# EasyEDA Pro project ProProject_IMUSensorNodes202312.epro, board 6_6_拼板20240123（带编号） (continued)
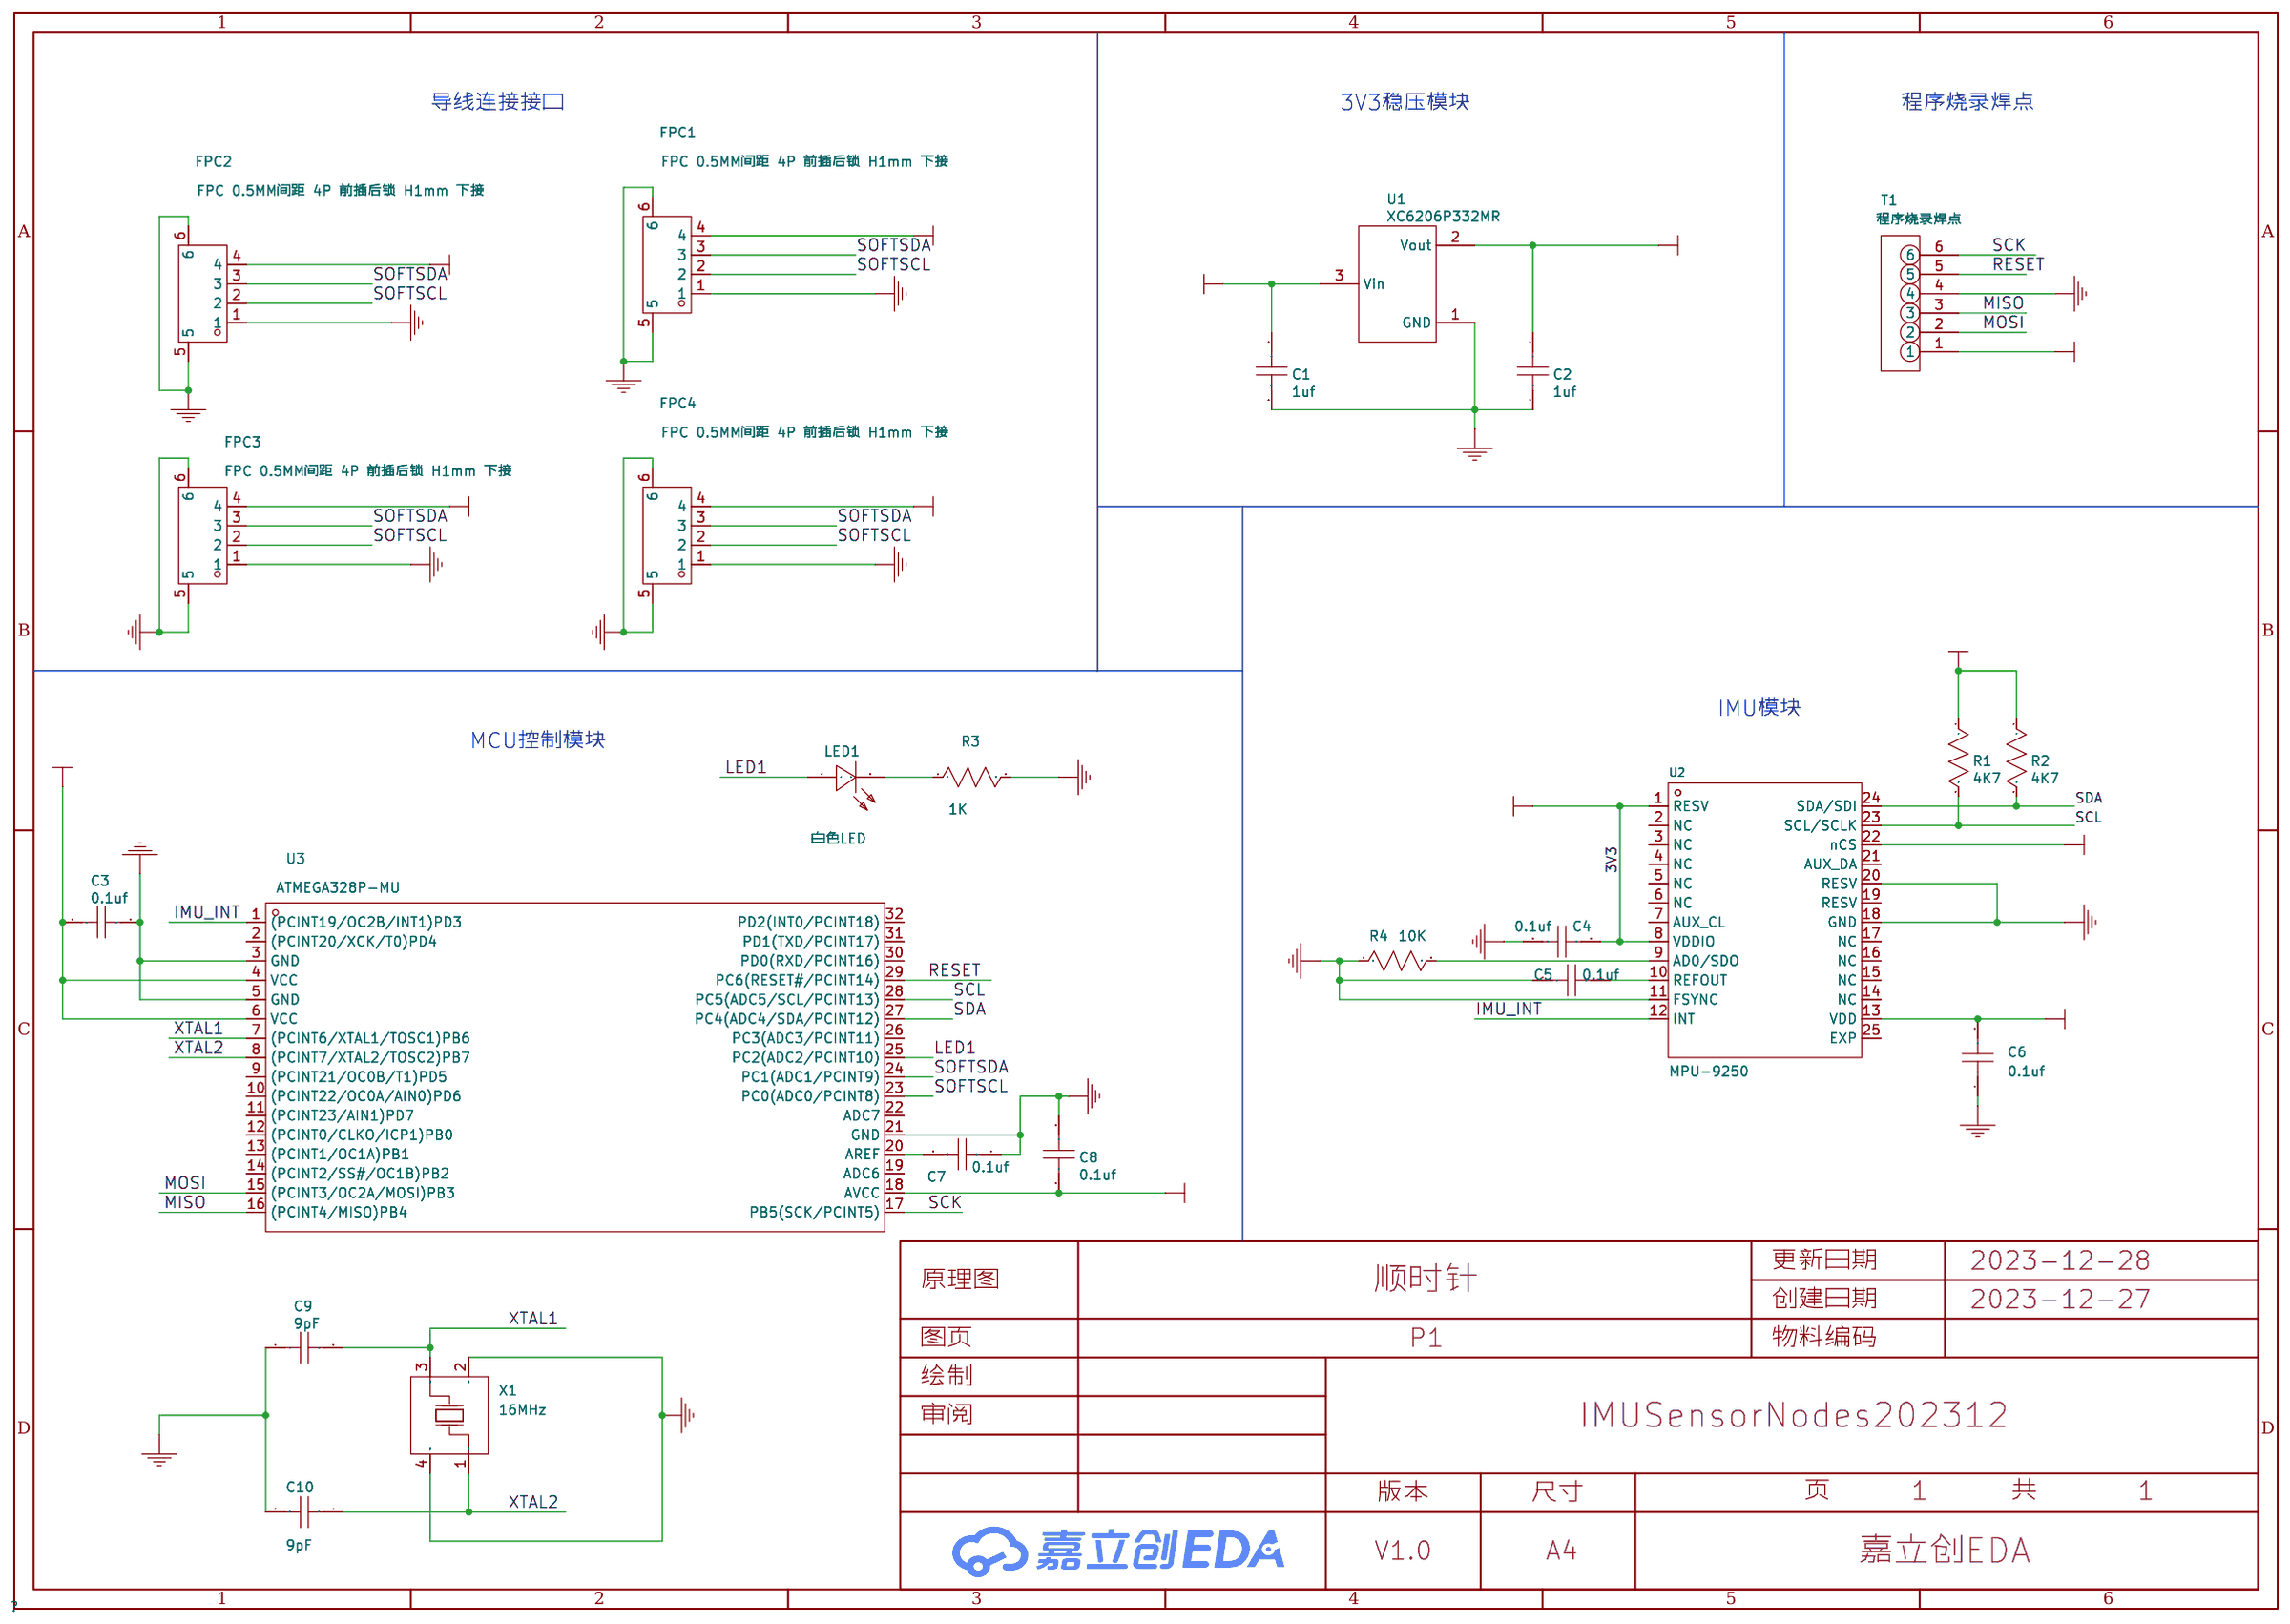
[diagram p0: schematic sheet]
## Nets (continued)
Designator#910.5 Designator#910.21 Designator#910.33 Designator#911.11 Designator#911.18 Designator#911.20 Designator#911.25 Designator#912.11 Designator#912.18 Designator#912.20 Designator#912.25 Designator#913.3 Designator#913.5 Designator#913.21 Designator#913.33 Designator#914.4 Designator#915.11 Designator#915.18 Designator#915.20 Designator#915.25 Designator#916.3 Designator#916.5 Designator#916.21 Designator#916.33 Designator#917.3 Designator#917.5 Designator#917.21 Designator#917.33 Designator#918.11 Designator#918.18 Designator#918.20 Designator#918.25 Designator#919.11 Designator#919.18 Designator#919.20 Designator#919.25 Designator#920.3 Designator#920.5 Designator#920.21 Designator#920.33 Designator#921.11 Designator#921.18 Designator#921.20 Designator#921.25 Designator#922.4 Designator#923.11 Designator#923.18 Designator#923.20 Designator#923.25 Designator#924.4
IMU_INT: Designator#313.1 Designator#314.12 Designator#317.12 Designator#318.12 Designator#319.12 Designator#321.1 Designator#322.1 Designator#323.12 Designator#324.1 Designator#325.1 Designator#326.12 Designator#437.12 Designator#438.12 Designator#440.1 Designator#801.1 Designator#803.1 Designator#806.1 Designator#808.1 Designator#809.1 Designator#810.1 Designator#811.1 Designator#813.12 Designator#814.12 Designator#818.12 Designator#819.12 Designator#820.1 Designator#822.1 Designator#826.12 Designator#827.1 Designator#829.1 Designator#830.12 Designator#831.12 Designator#832.1 Designator#835.1 Designator#836.12 Designator#837.1 Designator#838.1 Designator#839.1 Designator#877.12 Designator#878.12 Designator#880.12 Designator#881.12 Designator#882.12 Designator#883.12 Designator#885.1 Designator#886.12 Designator#888.12 Designator#889.1 Designator#890.12 Designator#892.1 Designator#895.1 Designator#896.1 Designator#897.12 Designator#900.12 Designator#901.12 Designator#902.1 Designator#903.1 Designator#904.1 Designator#906.1 Designator#909.12 Designator#910.1 Designator#911.12 Designator#912.12 Designator#913.1 Designator#915.12 Designator#916.1 Designator#917.1 Designator#918.12 Designator#919.12 Designator#920.1 Designator#921.12 Designator#923.12
LED1: Designator#246.1 Designator#247.1 Designator#248.1 Designator#249.1 Designator#250.1 Designator#251.1 Designator#252.1 Designator#253.1 Designator#254.1 Designator#255.1 Designator#256.1 Designator#257.1 Designator#258.1 Designator#259.1 Designator#260.1 Designator#261.1 Designator#262.1 Designator#263.1 Designator#264.1 Designator#265.1 Designator#266.1 Designator#267.1 Designator#268.1 Designator#269.1 Designator#270.1 Designator#271.1 Designator#272.1 Designator#273.1 Designator#274.1 Designator#275.1 Designator#276.1 Designator#277.1 Designator#278.1 Designator#279.1 Designator#280.1 Designator#281.1 Designator#313.25 Designator#321.25 Designator#322.25 Designator#324.25 Designator#325.25 Designator#440.25 Designator#801.25 Designator#803.25 Designator#806.25 Designator#808.25 Designator#809.25 Designator#810.25 Designator#811.25 Designator#820.25 Designator#822.25 Designator#827.25 Designator#829.25 Designator#832.25 Designator#835.25 Designator#837.25 Designator#838.25 Designator#839.25 Designator#885.25 Designator#889.25 Designator#892.25 Designator#895.25 Designator#896.25 Designator#902.25 Designator#903.25 Designator#904.25 Designator#906.25 Designator#910.25 Designator#913.25 Designator#916.25 Designator#917.25 Designator#920.25
MISO: Designator#313.16 Designator#315.3 Designator#316.3 Designator#320.3 Designator#321.16 Designator#322.16 Designator#324.16 Designator#325.16 Designator#327.3 Designator#436.3 Designator#439.3 Designator#440.16 Designator#801.16 Designator#802.3 Designator#803.16 Designator#804.3 Designator#805.3 Designator#806.16 Designator#807.3 Designator#808.16 Designator#809.16 Designator#810.16 Designator#811.16 Designator#812.3 Designator#815.3 Designator#816.3 Designator#817.3 Designator#820.16 Designator#821.3 Designator#822.16 Designator#823.3 Designator#824.3 Designator#825.3 Designator#827.16 Designator#828.3 Designator#829.16 Designator#832.16 Designator#833.3 Designator#834.3 Designator#835.16 Designator#837.16 Designator#838.16 Designator#839.16 Designator#876.3 Designator#879.3 Designator#884.3 Designator#885.16 Designator#887.3 Designator#889.16 Designator#891.3 Designator#892.16 Designator#893.3 Designator#894.3 Designator#895.16 Designator#896.16 Designator#898.3 Designator#899.3 Designator#902.16 Designator#903.16 Designator#904.16 Designator#905.3 Designator#906.16 Designator#907.3 Designator#908.3 Designator#910.16 Designator#913.16 Designator#914.3 Designator#916.16 Designator#917.16 Designator#920.16 Designator#922.3 Designator#924.3
MOSI: Designator#313.15 Designator#315.2 Designator#316.2 Designator#320.2 Designator#321.15 Designator#322.15 Designator#324.15 Designator#325.15 Designator#327.2 Designator#436.2 Designator#439.2 Designator#440.15 Designator#801.15 Designator#802.2 Designator#803.15 Designator#804.2 Designator#805.2 Designator#806.15 Designator#807.2 Designator#808.15 Designator#809.15 Designator#810.15 Designator#811.15 Designator#812.2 Designator#815.2 Designator#816.2 Designator#817.2 Designator#820.15 Designator#821.2 Designator#822.15 Designator#823.2 Designator#824.2 Designator#825.2 Designator#827.15 Designator#828.2 Designator#829.15 Designator#832.15 Designator#833.2 Designator#834.2 Designator#835.15 Designator#837.15 Designator#838.15 Designator#839.15 Designator#876.2 Designator#879.2 Designator#884.2 Designator#885.15 Designator#887.2 Designator#889.15 Designator#891.2 Designator#892.15 Designator#893.2 Designator#894.2 Designator#895.15 Designator#896.15 Designator#898.2 Designator#899.2 Designator#902.15 Designator#903.15 Designator#904.15 Designator#905.2 Designator#906.15 Designator#907.2 Designator#908.2 Designator#910.15 Designator#913.15 Designator#914.2 Designator#916.15 Designator#917.15 Designator#920.15 Designator#922.2 Designator#924.2
RESET: Designator#7.5 Designator#7.6 Designator#8.5 Designator#8.6 Designator#10.5 Designator#10.6 Designator#16.5 Designator#16.6 Designator#19.5 Designator#19.6 Designator#85.5 Designator#85.6 Designator#88.5 Designator#88.6 Designator#89.5 Designator#89.6 Designator#90.5 Designator#90.6 Designator#96.5 Designator#96.6 Designator#101.5 Designator#101.6 Designator#102.5 Designator#102.6 Designator#105.5 Designator#105.6 Designator#107.5 Designator#107.6 Designator#108.5 Designator#108.6 Designator#149.5 Designator#149.6 Designator#153.5 Designator#153.6 Designator#154.5 Designator#154.6 Designator#161.5 Designator#161.6 Designator#163.5 Designator#163.6 Designator#172.5 Designator#172.6 Designator#174.5 Designator#174.6 Designator#177.5 Designator#177.6 Designator#216.5 Designator#216.6 Designator#222.5 Designator#222.6 Designator#223.5 Designator#223.6 Designator#224.5 Designator#224.6 Designator#227.5 Designator#227.6 Designator#236.5 Designator#236.6 Designator#240.5 Designator#240.6 Designator#242.5 Designator#242.6 Designator#245.5 Designator#245.6 Designator#285.5 Designator#285.6 Designator#293.5 Designator#293.6 Designator#295.5 Designator#295.6 Designator#306.5 Designator#306.6 Designator#313.29 Designator#315.5 Designator#316.5 Designator#320.5 Designator#321.29 Designator#322.29 Designator#324.29 Designator#325.29 Designator#327.5 Designator#436.5 Designator#439.5 Designator#440.29 Designator#801.29 Designator#802.5 Designator#803.29 Designator#804.5 Designator#805.5 Designator#806.29 Designator#807.5 Designator#808.29 Designator#809.29 Designator#810.29 Designator#811.29 Designator#812.5 Designator#815.5 Designator#816.5 Designator#817.5 Designator#820.29 Designator#821.5 Designator#822.29 Designator#823.5 Designator#824.5 Designator#825.5 Designator#827.29 Designator#828.5 Designator#829.29 Designator#832.29 Designator#833.5 Designator#834.5 Designator#835.29 Designator#837.29 Designator#838.29 Designator#839.29 Designator#876.5 Designator#879.5 Designator#884.5 Designator#885.29 Designator#887.5 Designator#889.29 Designator#891.5 Designator#892.29 Designator#893.5 Designator#894.5 Designator#895.29 Designator#896.29 Designator#898.5 Designator#899.5 Designator#902.29 Designator#903.29 Designator#904.29 Designator#905.5 Designator#906.29 Designator#907.5 Designator#908.5 Designator#910.29 Designator#913.29 Designator#914.5 Designator#916.29 Designator#917.29 Designator#920.29 Designator#922.5 Designator#924.5
SCK: Designator#313.17 Designator#315.6 Designator#316.6 Designator#320.6 Designator#321.17 Designator#322.17 Designator#324.17 Designator#325.17 Designator#327.6 Designator#436.6 Designator#439.6 Designator#440.17 Designator#801.17 Designator#802.6 Designator#803.17 Designator#804.6 Designator#805.6 Designator#806.17 Designator#807.6 Designator#808.17 Designator#809.17 Designator#810.17 Designator#811.17 Designator#812.6 Designator#815.6 Designator#816.6 Designator#817.6 Designator#820.17 Designator#821.6 Designator#822.17 Designator#823.6 Designator#824.6 Designator#825.6 Designator#827.17 Designator#828.6 Designator#829.17 Designator#832.17 Designator#833.6 Designator#834.6 Designator#835.17 Designator#837.17 Designator#838.17 Designator#839.17 Designator#876.6 Designator#879.6 Designator#884.6 Designator#885.17 Designator#887.6 Designator#889.17 Designator#891.6 Designator#892.17 Designator#893.6 Designator#894.6 Designator#895.17 Designator#896.17 Designator#898.6 Designator#899.6 Designator#902.17 Designator#903.17 Designator#904.17 Designator#905.6 Designator#906.17 Designator#907.6 Designator#908.6 Designator#910.17 Designator#913.17 Designator#914.6 Designator#916.17 Designator#917.17 Designator#920.17 Designator#922.6 Designator#924.6
SCL: Designator#313.28 Designator#314.23 Designator#317.23 Designator#318.23 Designator#319.23 Designator#321.28 Designator#322.28 Designator#323.23 Designator#324.28 Designator#325.28 Designator#326.23 Designator#330.2 Designator#333.2 Designator#336.2 Designator#339.2 Designator#342.2 Designator#345.2 Designator#348.2 Designator#351.2 Designator#354.2 Designator#357.2 Designator#360.2 Designator#363.2 Designator#365.2 Designator#368.2 Designator#371.2 Designator#374.2 Designator#377.2 Designator#380.2 Designator#383.2 Designator#386.2 Designator#389.2 Designator#392.2 Designator#395.2 Designator#398.2 Designator#401.2 Designator#404.2 Designator#407.2 Designator#410.2 Designator#413.2 Designator#416.2 Designator#419.2 Designator#422.2 Designator#425.2 Designator#428.2 Designator#431.2 Designator#434.2 Designator#437.23 Designator#438.23 Designator#440.28 Designator#801.28 Designator#803.28 Designator#806.28 Designator#808.28 Designator#809.28 Designator#810.28 Designator#811.28 Designator#813.23 Designator#814.23 Designator#818.23 Designator#819.23 Designator#820.28 Designator#822.28 Designator#826.23 Designator#827.28 Designator#829.28 Designator#830.23 Designator#831.23 Designator#832.28 Designator#835.28 Designator#836.23 Designator#837.28 Designator#838.28 Designator#839.28 Designator#877.23 Designator#878.23 Designator#880.23 Designator#881.23 Designator#882.23 Designator#883.23 Designator#885.28 Designator#886.23 Designator#888.23 Designator#889.28 Designator#890.23 Designator#892.28 Designator#895.28 Designator#896.28 Designator#897.23 Designator#900.23 Designator#901.23 Designator#902.28 Designator#903.28 Designator#904.28 Designator#906.28 Designator#909.23 Designator#910.28 Designator#911.23 Designator#912.23 Designator#913.28 Designator#915.23 Designator#916.28 Designator#917.28 Designator#918.23 Designator#919.23 Designator#920.28 Designator#921.23 Designator#923.23
